# EasyEDA Pro project Athena.epro, schematic Schematic, sheet 2 of 4

## Sheets
2 Power: Page Name: Power
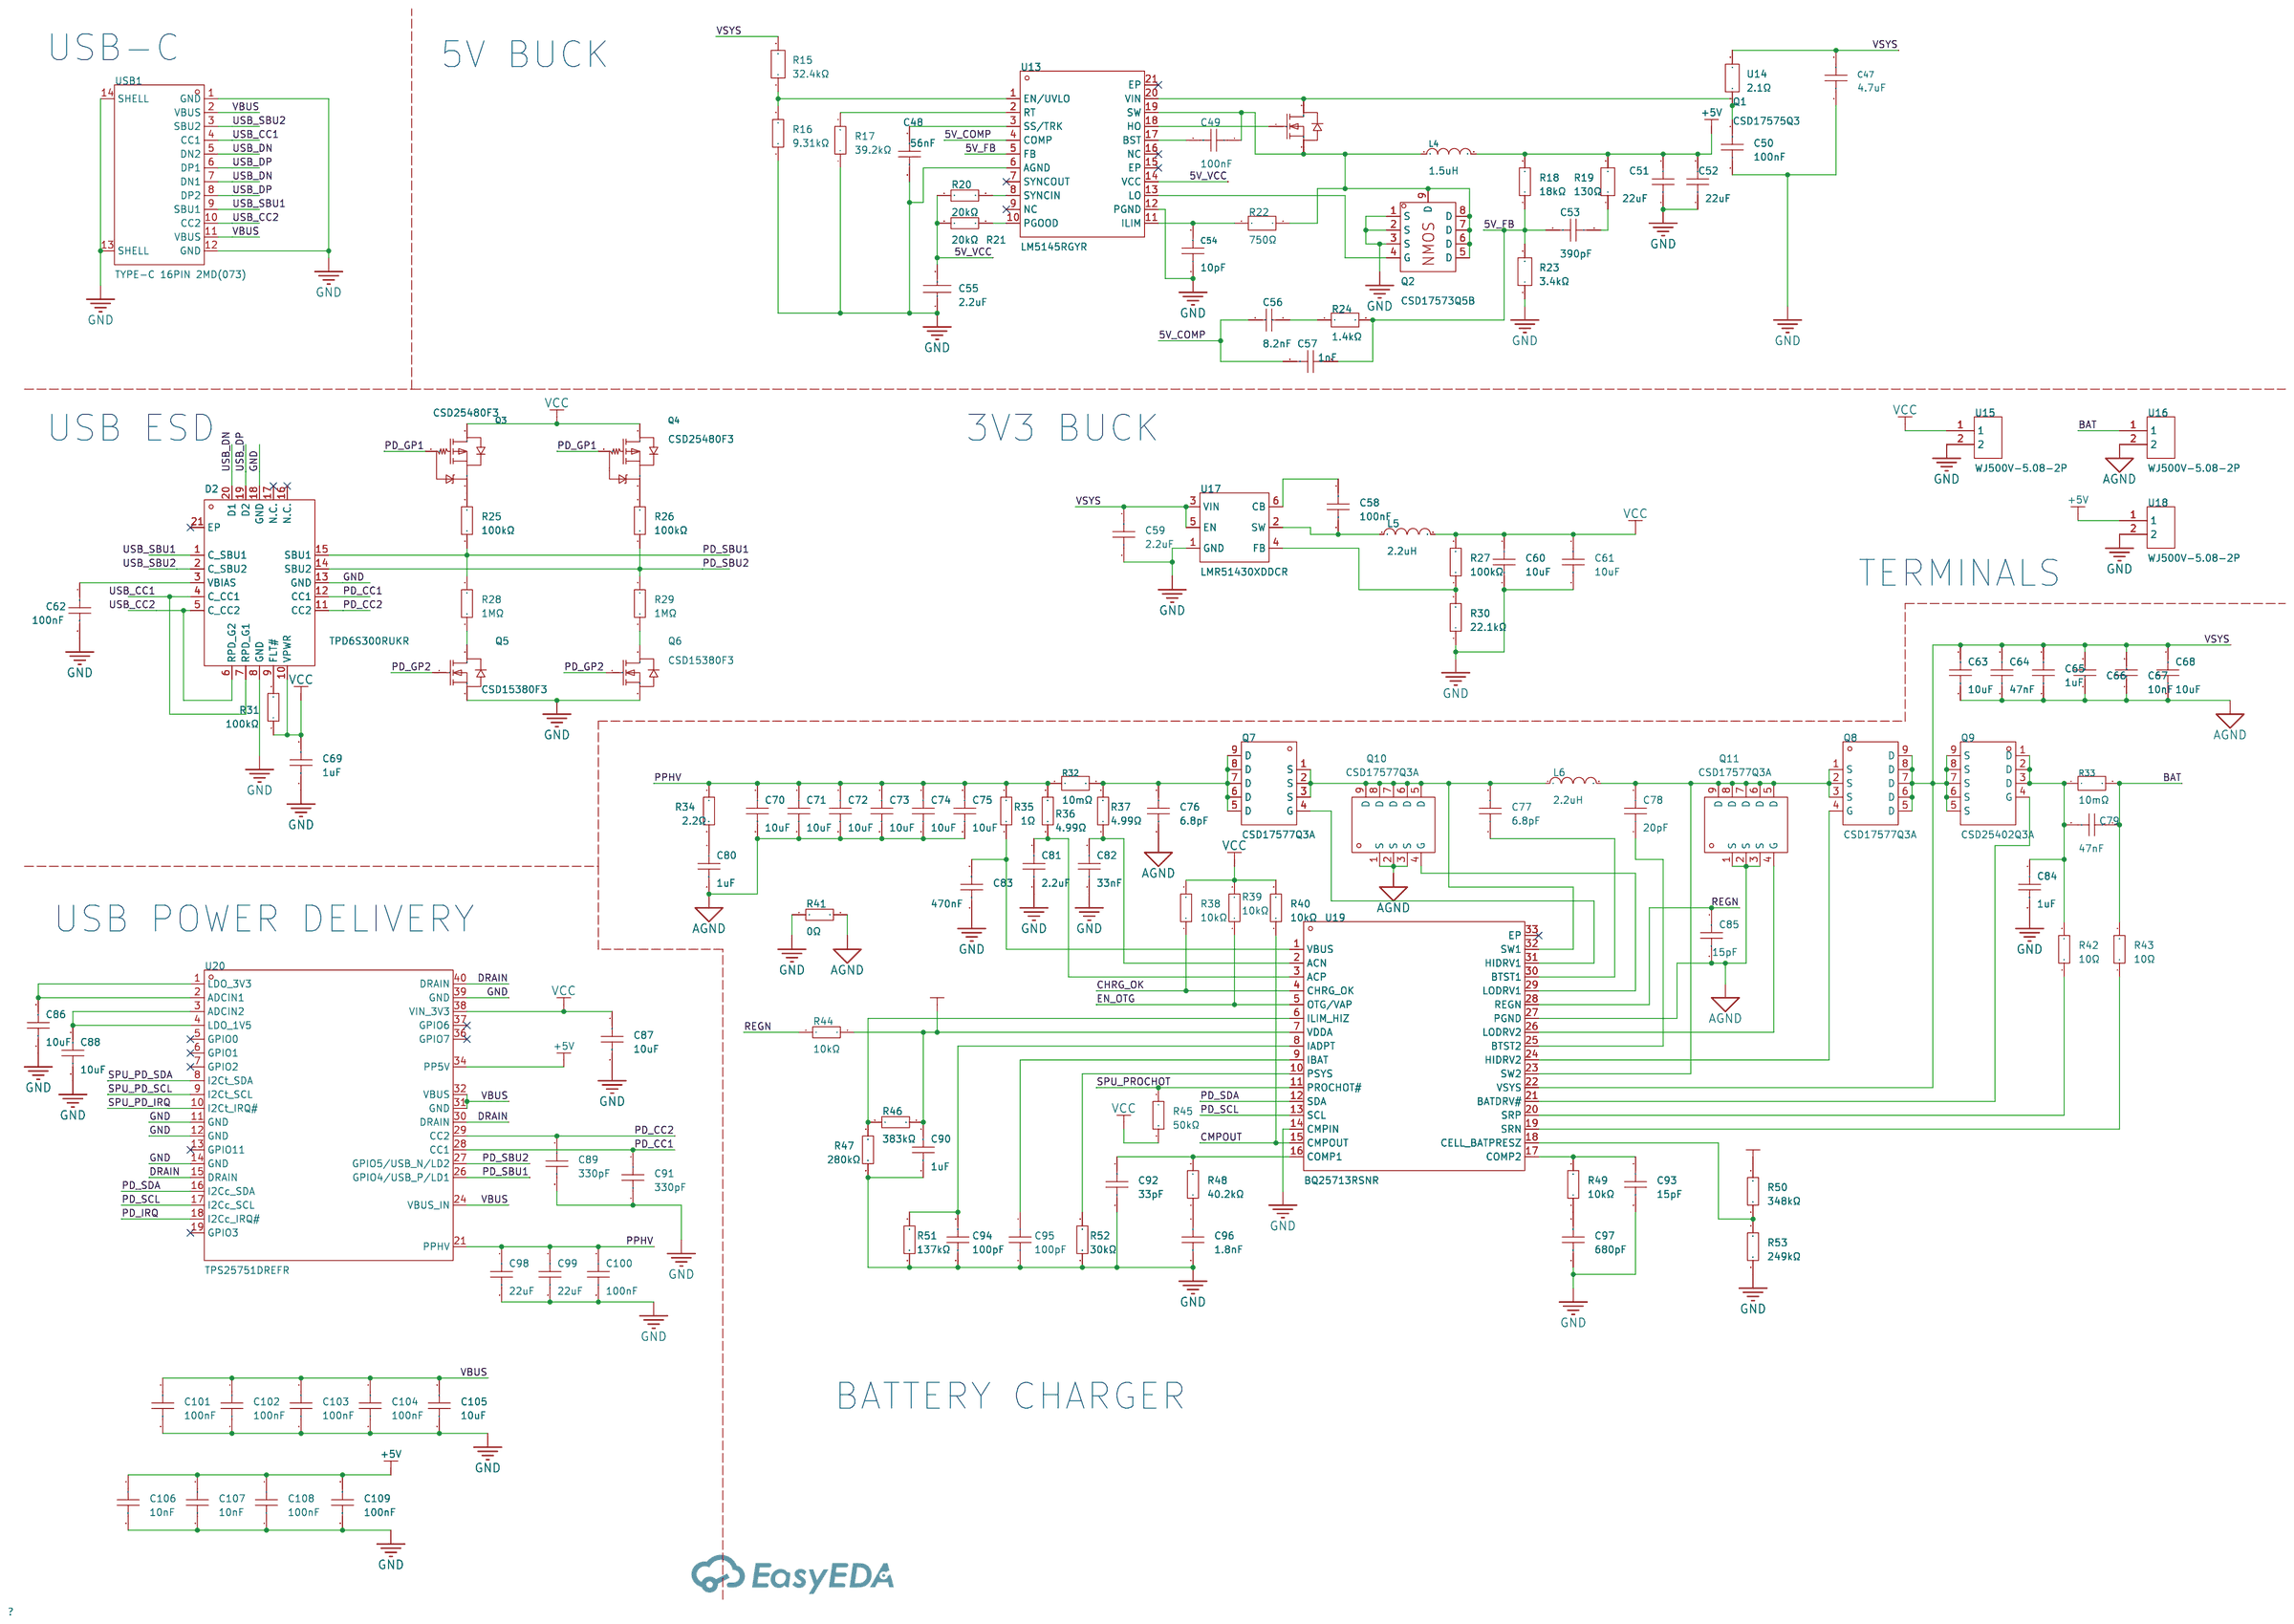
[diagram p1: Power]

## Parts
C47  4.7uF  [C1210]
C48  56nF  [C0603]
C49  100nF  [C0603]
C50  100nF  [C0603]
C51  22uF  [C0805]
C52  22uF  [C0805]
C53  390pF  [C0402]
C54  10pF  [C0603]
C55  2.2uF  [C0402]
C56  8.2nF  [C0402]
C57  1nF  [C0402]
C58  100nF  [C0402]
C59  2.2uF  [C0805]
C60  10uF  [C0603]
C61  10uF  [C0603]
C62  100nF  [C0402]
C63  10uF  [C0805]
C64  47nF  [C0805]
C65  1uF  [C0805]
C66  100pF  [C0805]
C67  10nF  [C0805]
C68  10uF  [C0805]
C69  1uF  [C0402]
C70  10uF  [C0805]
C71  10uF  [C0805]
C72  10uF  [C0805]
C73  10uF  [C0805]
C74  10uF  [C0805]
C75  10uF  [C0805]
C76  6.8pF  [C0603]
C77  6.8pF  [C0603]
C78  20pF  [C0603]
C79  47nF  [C0402]
C80  1uF  [C0402]
C81  2.2uF  [C0603]
C82  33nF  [C0603]
C83  470nF  [C0603]
C84  1uF  [C0402]
C85  15pF  [C0402]
C86  10uF  [C0402]
C87  10uF  [C0402]
C88  10uF  [C0402]
C89  330pF  [C0402]
C90  1uF  [C0402]
C91  330pF  [C0402]
C92  33pF  [C0402]
C93  15pF  [C0402]
C94  100pF  [C0402]
C95  100pF  [C0402]
C96  1.8nF  [C0402]
C97  680pF  [C0402]
C98  22uF  [C0805]
C99  22uF  [C0805]
C100  100nF  [C0402]
C101  100nF  [C0402]
C102  100nF  [C0402]
C103  100nF  [C0402]
C104  100nF  [C0402]
C105  10uF  [C0805]
C106  10nF  [C0402]
C107  10nF  [C0402]
C108  100nF  [C0805]
C109  100nF  [C0805]
D2  TPD6S300RUKR  [WQFN-20_L3.0-W3.0-P0.40-BL-EP1.7]
L4  1.5uH  [IND-SMD_L11.5-W10.0_104CDMCCDS]
L5  2.2uH  [L1206]
L6  2.2uH  [IND-SMD_L4.4-W4.2]
Q1  CSD17575Q3  [VSON-CLIP-8_L3.3-W3.3-P0.65-BL]
Q2  CSD17573Q5B  [POWERVDFN-8_L6.0-W5.0-P1.27-BL]
Q3  CSD25480F3  [PICOSTAR-3_L0.7-W0.6-P0.40-TL]
Q4  CSD25480F3  [PICOSTAR-3_L0.7-W0.6-P0.40-TL]
Q5  CSD15380F3  [PICOSTAR-3_L0.7-W0.6-P0.35-TL]
Q6  CSD15380F3  [PICOSTAR-3_L0.7-W0.6-P0.35-TL]
Q7  CSD17577Q3A  [VSONP-8_L3.1-W3.1-P0.65-LS3.5-BL]
Q8  CSD17577Q3A  [VSONP-8_L3.1-W3.1-P0.65-LS3.5-BL]
Q9  CSD25402Q3A  [VSONP-8_L3.1-W3.1-P0.65-LS3.5-BL]
Q10  CSD17577Q3A  [VSONP-8_L3.1-W3.1-P0.65-LS3.5-BL]
Q11  CSD17577Q3A  [VSONP-8_L3.1-W3.1-P0.65-LS3.5-BL]
R15  32.4kΩ  [R0603]
R16  9.31kΩ  [R0603]
R17  39.2kΩ  [R0402]
R18  18kΩ  [R0603]
R19  130Ω  [R0402]
R20  20kΩ  [R0603]
R21  20kΩ  [R0603]
R22  750Ω  [R0402]
R23  3.4kΩ  [R0402]
R24  1.4kΩ  [R0603]
R25  100kΩ  [R0402]
R26  100kΩ  [R0402]
R27  100kΩ  [R0402]
R28  1MΩ  [R0402]
R29  1MΩ  [R0402]
R30  22.1kΩ  [R0402]
R31  100kΩ  [R0402]
R32  10mΩ  [R1206]
R33  10mΩ  [R1206]
R34  2.2Ω  [R0402]
R35  1Ω  [R0402]
R36  4.99Ω  [R0402]
R37  4.99Ω  [R0402]
R38  10kΩ  [R0402]
R39  10kΩ  [R0402]
R40  10kΩ  [R0402]
R41  0Ω  [R0402]
R42  10Ω  [R0402]
R43  10Ω  [R0402]
R44  10kΩ  [R0402]
R45  50kΩ  [R0402]
R46  383kΩ  [R0402]
R47  280kΩ  [R0402]
R48  40.2kΩ  [R0402]
R49  10kΩ  [R0402]
R50  348kΩ  [R0402]
R51  137kΩ  [R0402]
R52  30kΩ  [R0402]
R53  249kΩ  [R0402]
U13  LM5145RGYR  [VQFN-20_L4.5-W3.5-P0.50-BL-EP]
U14  2.1Ω  [R0603]
U15  WJ500V-5.08-2P  [CONN-TH_2P-P5.00_WJ500V-5.08-2P]
U16  WJ500V-5.08-2P  [CONN-TH_2P-P5.00_WJ500V-5.08-2P]
U17  LMR51430XDDCR  [SOT-23-6_L2.9-W1.6-P0.95-LS2.8-BL]
U18  WJ500V-5.08-2P  [CONN-TH_2P-P5.00_WJ500V-5.08-2P]
U19  BQ25713RSNR  [QFN-32_L4.0-W4.0-P0.40-TL-EP2.8]
U20  TPS25751DREFR  [QFN-38_L6.0-W4.0-P0.40-TL-EP_TI_REF0038A]
USB1  TYPE-C 16PIN 2MD(073)  [USB-C-SMD_TYPE-C-6PIN-2MD-073]

## Library data of the parts
C47 = GRM32ER71H475KA88L: Capacitance: Tolerance:±10% Tolerance:±10% Voltage Rated: Temperature Coefficient:; LCSC Part Name: 4.7uF ±10% 50V; Supplier Part: C86052; Manufacturer: muRata(村田); Supplier Footprint: 1210; JLCPCB Part Class: Extended Part; Datasheet: https://atta.szlcsc.com/upload/public/pdf/source/20200305/C490387_23319AE8C154DEB24C505E6C82A8106A.pdf; Supplier: LCSC; Tolerance: ±10%
C48 = CC0603KRX7R9BB563: Capacitance: Tolerance:±10% Tolerance:±10% Voltage Rated: Temperature Coefficient:; LCSC Part Name: 56nF ±10% 50V; Supplier Part: C282072; Manufacturer: YAGEO(国巨); Supplier Footprint: 0603; JLCPCB Part Class: Extended Part; Datasheet: https://atta.szlcsc.com/upload/public/pdf/source/20180910/C282072_33301C7F631E79921B82A8DAC6BCC5B3.pdf; Supplier: LCSC; Tolerance: ±10%
C49 C50 = CC0603KRX7R9BB104: Capacitance:100nF Tolerance:±10% Tolerance:±10% Voltage Rating:50V Temperature Coefficient:X7R; LCSC Part Name: 100nF ±10% 50V; Supplier Part: C14663; Manufacturer: YAGEO(国巨); Supplier Footprint: 0603; JLCPCB Part Class: Basic Part; Datasheet: https://atta.szlcsc.com/upload/public/pdf/source/20250214/096C4C206003071F5D32E5F0D8E7F8DF.pdf; Supplier: LCSC; Tolerance: ±10%; Voltage Rating: 50V; Temperature Coefficient: X7R
C51 C52 = CL21A226MAYNNNE: Capacitance:22uF Tolerance:±20% Tolerance:±20% Voltage Rating:25V Temperature Coefficient:X5R; LCSC Part Name: 22uF ±20% 25V; Supplier Part: C602037; Manufacturer: SAMSUNG(三星); Supplier Footprint: 0805; JLCPCB Part Class: Extended Part; Datasheet: https://item.szlcsc.com/datasheet/CL21A226MAYNNNE/631473.html; Supplier: LCSC; Tolerance: ±20%; Voltage Rating: 25V; Temperature Coefficient: X5R
C53 = GRM155R71H391KA01D: Capacitance: Tolerance:±10% Tolerance:±10% Voltage Rated: Temperature Coefficient:; LCSC Part Name: 390pF ±10% 50V NRND物料(将要停产) 原厂不接订单; Supplier Part: C185563; Manufacturer: muRata(村田); Supplier Footprint: 0402; JLCPCB Part Class: Extended Part; Datasheet: https://atta.szlcsc.com/upload/public/pdf/source/20190725/C185563_90001B6F14E9F7B861ADEBE8CCB1D839.pdf; Supplier: LCSC; Tolerance: ±10%
C54 = CC0603JRNPO0BN100: Capacitance: Tolerance:±5% Tolerance:±5% Voltage Rated: Temperature Coefficient:; LCSC Part Name: 10pF ±5% 100V; Supplier Part: C576799; Manufacturer: YAGEO(国巨); Supplier Footprint: 0603; JLCPCB Part Class: Extended Part; Datasheet: https://atta.szlcsc.com/upload/public/pdf/source/20200814/C576799_FFC052976BB908963E8862AC2CBE779D.pdf; Supplier: LCSC; Tolerance: ±5%
C55 = CL05A225MQ5NSNC: Capacitance:2.2uF Tolerance:±20% Tolerance:±20% Voltage Rating:6.3V Temperature Coefficient:X5R; LCSC Part Name: 2.2uF ±20% 6.3V; Supplier Part: C12530; Manufacturer: SAMSUNG(三星); Supplier Footprint: 0402; JLCPCB Part Class: Basic Part; Datasheet: https://item.szlcsc.com/datasheet/CL05A225MQ5NSNC/13164.html; Supplier: LCSC; Tolerance: ±20%; Voltage Rating: 6.3V; Temperature Coefficient: X5R
C56 = CC0402KRX7R9BB822: Capacitance: Tolerance:±10% Tolerance:±10% Voltage Rated: Temperature Coefficient:; LCSC Part Name: 8.2nF ±10% 50V; Supplier Part: C107032; Manufacturer: YAGEO(国巨); Supplier Footprint: 0402; JLCPCB Part Class: Extended Part; Datasheet: https://atta.szlcsc.com/upload/public/pdf/source/20170914/C128857_1505359892143968080.pdf; Supplier: LCSC; Tolerance: ±10%
C57 = TCC0402X7R102M500AT: Capacitance:1000pF Tolerance:±20% Tolerance:±20% Voltage Rating:50V Temperature Coefficient:X7R; LCSC Part Name: 1nF ±20% 50V; Supplier Part: C696907; Manufacturer: CCTC(三环); Supplier Footprint: 0402; JLCPCB Part Class: Extended Part; Datasheet: https://atta.szlcsc.com/upload/public/pdf/source/20200707/C696841_89A2C111301AB76AE7642008585E7A11.pdf; Supplier: LCSC; Tolerance: ±20%; Voltage Rating: 50V; Temperature Coefficient: X7R
C58 C62 C100-C104 = GRM155R71H104KE14D: Capacitance: Tolerance:±10% Tolerance:±10% Voltage Rated: Temperature Coefficient:; LCSC Part Name: 100nF ±10% 50V; Supplier Part: C77020; Manufacturer: muRata(村田); Supplier Footprint: 0402; JLCPCB Part Class: Extended Part; Datasheet: https://atta.szlcsc.com/upload/public/pdf/source/20180326/C77020_39BD49C951FF1AF0DB1F1FAC5AC1E401.pdf; Supplier: LCSC; Tolerance: ±10%; Standardization Check: false
C59 = CL21A225KBQNNNE: Capacitance:2.2uF Tolerance:±10% Tolerance:±10% Voltage Rating:50V Temperature Coefficient:X5R; LCSC Part Name: 2.2uF ±10% 50V; Supplier Part: C377773; Manufacturer: SAMSUNG(三星); Supplier Footprint: 0805; JLCPCB Part Class: Basic Part; Datasheet: https://item.szlcsc.com/datasheet/CL21A225KBQNNNE/350246.html; Supplier: LCSC; Tolerance: ±10%; Voltage Rating: 50V; Temperature Coefficient: X5R; Standardization Check: false
C60 C61 = CL10A106MA8NRNC: Capacitance:10uF Tolerance:±20% Tolerance:±20% Voltage Rating:25V Temperature Coefficient:X5R; LCSC Part Name: 10uF ±20% 25V; Supplier Part: C96446; Manufacturer: SAMSUNG(三星); Supplier Footprint: 0603; JLCPCB Part Class: Basic Part; Datasheet: https://item.szlcsc.com/datasheet/CL10A106MA8NRNC/97651.html; Supplier: LCSC; Tolerance: ±20%; Voltage Rating: 25V; Temperature Coefficient: X5R; Standardization Check: false
C63 C68 C70-C75 = GRM21BR61H106KE43L: Capacitance: Tolerance:±10% Tolerance:±10% Voltage Rated: Temperature Coefficient:; LCSC Part Name: 10uF ±10% 50V; Supplier Part: C440198; Manufacturer: muRata(村田); Supplier Footprint: 0805; JLCPCB Part Class: Basic Part; Datasheet: https://atta.szlcsc.com/upload/public/pdf/source/20230811/95AAE0C9AF55EDC31B7A4D8B733F534E.pdf; Supplier: LCSC; Tolerance: ±10%; Standardization Check: false
C64 = CL21B473KBCNNNC: Capacitance: Tolerance:±10% Tolerance:±10% Voltage Rated: Temperature Coefficient:; LCSC Part Name: 47nF ±10% 50V; Supplier Part: C53134; Manufacturer: SAMSUNG(三星); Supplier Footprint: 0805; JLCPCB Part Class: Basic Part; Datasheet: https://atta.szlcsc.com/upload/public/pdf/source/20160218/1457707763339.pdf; Supplier: LCSC; Tolerance: ±10%
C65 = CL21B105KBFNNNE: Capacitance:1uF Tolerance:±10% Tolerance:±10% Voltage Rating:50V Temperature Coefficient:X7R; LCSC Part Name: 1uF ±10% 50V; Supplier Part: C28323; Manufacturer: SAMSUNG(三星); Supplier Footprint: 0805; JLCPCB Part Class: Basic Part; Datasheet: https://item.szlcsc.com/datasheet/CL21B105KBFNNNE/29074.html; Supplier: LCSC; Tolerance: ±10%; Voltage Rating: 50V; Temperature Coefficient: X7R
C66 = CL21C101JBANNNC: Capacitance:100pF Tolerance:±5% Tolerance:±5% Voltage Rating:50V Temperature Coefficient:C0G; LCSC Part Name: 100pF ±5% 50V; Supplier Part: C1790; Manufacturer: SAMSUNG(三星); Supplier Footprint: 0805; JLCPCB Part Class: Basic Part; Datasheet: https://item.szlcsc.com/datasheet/CL21C101JBANNNC/2142.html; Supplier: LCSC; Tolerance: ±5%; Voltage Rating: 50V; Temperature Coefficient: C0G
C67 = CL21B103KBANNNC: Capacitance:10nF Tolerance:±10% Tolerance:±10% Voltage Rating:50V Temperature Coefficient:X7R; LCSC Part Name: 10nF ±10% 50V; Supplier Part: C1710; Manufacturer: SAMSUNG(三星); Supplier Footprint: 0805; JLCPCB Part Class: Basic Part; Datasheet: https://item.szlcsc.com/datasheet/CL21B103KBANNNC/2062.html; Supplier: LCSC; Tolerance: ±10%; Voltage Rating: 50V; Temperature Coefficient: X7R
C69 C80 C84 C90 = CL05A105KA5NQNC: Capacitance:1uF Tolerance:±10% Tolerance:±10% Voltage Rating:25V Temperature Coefficient:X5R; LCSC Part Name: 1uF ±10% 25V; Supplier Part: C52923; Manufacturer: SAMSUNG(三星); Supplier Footprint: 0402; JLCPCB Part Class: Basic Part; Datasheet: https://item.szlcsc.com/datasheet/CL05A105KA5NQNC/53938.html; Supplier: LCSC; Tolerance: ±10%; Voltage Rating: 25V; Temperature Coefficient: X5R; Standardization Check: false
C76 C77 = CC0603CRNPO9BN6R8: Capacitance:6.8pF Voltage Rating:50V Temperature Coefficient:NP0; LCSC Part Name: ±0.25pF 6.8pF 50V; Supplier Part: C282251; Manufacturer: YAGEO(国巨); Supplier Footprint: 0603; JLCPCB Part Class: Extended Part; Datasheet: https://item.szlcsc.com/datasheet/CC0603CRNPO9BN6R8/268271.html; Supplier: LCSC; Voltage Rating: 50V; Temperature Coefficient: NP0
C78 = CC0603JRNPO9BN200: Capacitance: Tolerance:±5% Tolerance:±5% Voltage Rated: Temperature Coefficient:; LCSC Part Name: 20pF ±5% 50V; Supplier Part: C105621; Manufacturer: YAGEO(国巨); Supplier Footprint: 0603; JLCPCB Part Class: Extended Part; Datasheet: https://atta.szlcsc.com/upload/public/pdf/source/20170505/1493957838062.pdf; Supplier: LCSC; Tolerance: ±5%
C79 = CC0402KRX7R9BB473: Capacitance:47nF Tolerance:±10% Tolerance:±10% Voltage Rating:50V Temperature Coefficient:X7R; LCSC Part Name: 47nF ±10% 50V; Supplier Part: C272875; Manufacturer: YAGEO(国巨); Supplier Footprint: 0402; JLCPCB Part Class: Extended Part; Datasheet: https://item.szlcsc.com/datasheet/CC0402KRX7R9BB473/261267.html; Supplier: LCSC; Tolerance: ±10%; Voltage Rating: 50V; Temperature Coefficient: X7R; Standardization Check: false
C81 = CL10A225KB8NNNC: Capacitance:2.2uF Tolerance:±10% Tolerance:±10% Voltage Rating:50V Temperature Coefficient:X5R; LCSC Part Name: 2.2uF ±10% 50V; Supplier Part: C913904; Manufacturer: SAMSUNG(三星); Supplier Footprint: 0603; JLCPCB Part Class: Extended Part; Datasheet: https://item.szlcsc.com/datasheet/CL10A225KB8NNNC/984470.html; Supplier: LCSC; Tolerance: ±10%; Voltage Rating: 50V; Temperature Coefficient: X5R
C82 = CL10B333KB8NNNC: Capacitance:33nF Tolerance:±10% Tolerance:±10% Voltage Rating:50V Temperature Coefficient:X7R; LCSC Part Name: 33nF ±10% 50V; Supplier Part: C21117; Manufacturer: SAMSUNG(三星); Supplier Footprint: 0603; JLCPCB Part Class: Basic Part; Datasheet: https://item.szlcsc.com/datasheet/CL10B333KB8NNNC/21829.html; Supplier: LCSC; Tolerance: ±10%; Voltage Rating: 50V; Temperature Coefficient: X7R; Standardization Check: false
C83 = CC0603KRX7R9BB474: Capacitance:470nF Tolerance:±10% Tolerance:±10% Voltage Rating:50V Temperature Coefficient:X7R; LCSC Part Name: 470nF ±10% 50V; Supplier Part: C513577; Manufacturer: YAGEO(国巨); Supplier Footprint: 0603; JLCPCB Part Class: Extended Part; Datasheet: https://item.szlcsc.com/datasheet/CC0603KRX7R9BB474/528404.html; Supplier: LCSC; Tolerance: ±10%; Voltage Rating: 50V; Temperature Coefficient: X7R; Standardization Check: false
C85 C93 = 0402CG150J500NT: Capacitance:15pF Tolerance:±5% Tolerance:±5% Voltage Rating:50V Temperature Coefficient:C0G; LCSC Part Name: 15pF ±5% 50V; Supplier Part: C1548; Manufacturer: FH(风华); Supplier Footprint: 0402; JLCPCB Part Class: Basic Part; Datasheet: https://item.szlcsc.com/datasheet/0402CG150J500NT/1900.html; Supplier: LCSC; Tolerance: ±5%; Voltage Rating: 50V; Temperature Coefficient: C0G; Standardization Check: false
C86-C88 = CL05A106MP5NUNC_C315248: Capacitance:10uF Tolerance:±20% Tolerance:±20% Voltage Rating:10V Temperature Coefficient:X5R; LCSC Part Name: 10uF ±20% 10V; Supplier Part: C315248; Manufacturer: SAMSUNG(三星); Manufacturer Part: CL05A106MP5NUNC; Supplier Footprint: 0402; JLCPCB Part Class: Extended Part; Datasheet: https://item.szlcsc.com/datasheet/CL05A106MP5NUNC/297154.html; Supplier: LCSC; Tolerance: ±20%; Voltage Rating: 10V; Temperature Coefficient: X5R; Standardization Check: false
C89 C91 = CC0402KRX7R9BB331: Capacitance:330pF Tolerance:±10% Tolerance:±10% Voltage Rating:50V Temperature Coefficient:X7R; LCSC Part Name: 330pF ±10% 50V; Supplier Part: C106206; Manufacturer: YAGEO(国巨); Supplier Footprint: 0402; JLCPCB Part Class: Extended Part; Datasheet: https://item.szlcsc.com/datasheet/CC0402KRX7R9BB331/107421.html; Supplier: LCSC; Tolerance: ±10%; Voltage Rating: 50V; Temperature Coefficient: X7R; Standardization Check: false
C92 = CC0402JRNPO9BN330: Capacitance: Tolerance:±5% Tolerance:±5% Voltage Rated: Temperature Coefficient:; LCSC Part Name: 33pF ±5% 50V; Supplier Part: C107005; Manufacturer: YAGEO(国巨); Supplier Footprint: 0402; JLCPCB Part Class: Extended Part; Datasheet: https://atta.szlcsc.com/upload/public/pdf/source/20181008/C309499_21CC21451B82C39E3D92150FD6B30293.pdf; Supplier: LCSC; Tolerance: ±5%; Standardization Check: false
C94 C95 = 0402CG101J500NT: Capacitance: Tolerance:±5% Tolerance:±5% Voltage Rated: Temperature Coefficient:; LCSC Part Name: 100pF ±5% 50V; Supplier Part: C1546; Manufacturer: FH(风华); Supplier Footprint: 0402; JLCPCB Part Class: Basic Part; Datasheet: https://atta.szlcsc.com/upload/public/pdf/source/20200305/C486355_26A10D38EF8C2A5C37091D0039909270.pdf; Supplier: LCSC; Tolerance: ±5%; Standardization Check: false
C96 = CC0402JRX7R9BB182: Capacitance:1.8nF Tolerance:±5% Tolerance:±5% Voltage Rating:50V Temperature Coefficient:X7R; LCSC Part Name: 1.8nF ±5% 50V; Supplier Part: C527007; Manufacturer: YAGEO(国巨); Supplier Footprint: 0402; JLCPCB Part Class: Extended Part; Datasheet: https://item.szlcsc.com/datasheet/CC0402JRX7R9BB182/545433.html; Supplier: LCSC; Tolerance: ±5%; Voltage Rating: 50V; Temperature Coefficient: X7R; Standardization Check: false
C97 = CC0402KRX7R9BB681: Capacitance:680pF Tolerance:±10% Tolerance:±10% Voltage Rating:50V Temperature Coefficient:X7R; LCSC Part Name: 680pF ±10% 50V; Supplier Part: C107030; Manufacturer: YAGEO(国巨); Supplier Footprint: 0402; JLCPCB Part Class: Extended Part; Datasheet: https://item.szlcsc.com/datasheet/CC0402KRX7R9BB681/108246.html; Supplier: LCSC; Tolerance: ±10%; Voltage Rating: 50V; Temperature Coefficient: X7R; Standardization Check: false
C98 C99 = CL21A226MAQNNNE: Capacitance:22uF Tolerance:±20% Tolerance:±20% Voltage Rating:25V Temperature Coefficient:X5R; LCSC Part Name: 22uF ±20% 25V; Supplier Part: C45783; Manufacturer: SAMSUNG(三星); Supplier Footprint: 0805; JLCPCB Part Class: Basic Part; Datasheet: https://item.szlcsc.com/datasheet/CL21A226MAQNNNE/46786.html; Supplier: LCSC; Tolerance: ±20%; Voltage Rating: 25V; Temperature Coefficient: X5R; Standardization Check: false
C105 = GRM21BR61H106KE43L: Capacitance: Tolerance:±10% Tolerance:±10% Voltage Rated: Temperature Coefficient:; LCSC Part Name: 10uF ±10% 50V; Supplier Part: C440198; Manufacturer: muRata(村田); Supplier Footprint: 0805; JLCPCB Part Class: Basic Part; Datasheet: https://atta.szlcsc.com/upload/public/pdf/source/20230811/95AAE0C9AF55EDC31B7A4D8B733F534E.pdf; Supplier: LCSC; Tolerance: ±10%
C106 C107 = CL05B103KB5NNNC: Capacitance:10nF Tolerance:±10% Tolerance:±10% Voltage Rating:50V Temperature Coefficient:X7R; LCSC Part Name: 10nF ±10% 50V; Supplier Part: C15195; Manufacturer: SAMSUNG(三星); Supplier Footprint: 0402; JLCPCB Part Class: Basic Part; Datasheet: https://item.szlcsc.com/datasheet/CL05B103KB5NNNC/15869.html; Supplier: LCSC; Tolerance: ±10%; Voltage Rating: 50V; Temperature Coefficient: X7R; Standardization Check: false
C108 C109 = CC0805KRX7R9BB104: Capacitance:100nF Tolerance:±10% Tolerance:±10% Voltage Rating:50V Temperature Coefficient:X7R; LCSC Part Name: 100nF ±10% 50V; Supplier Part: C49678; Manufacturer: YAGEO(国巨); Supplier Footprint: 0805; JLCPCB Part Class: Basic Part; Datasheet: https://item.szlcsc.com/datasheet/CC0805KRX7R9BB104/50686.html; Supplier: LCSC; Tolerance: ±10%; Voltage Rating: 50V; Temperature Coefficient: X7R; Standardization Check: false
D2 = TPD6S300RUKR: Supplier Part: C2649810; Manufacturer: TI(德州仪器); Supplier Footprint: WQFN-20-EP(3x3); JLCPCB Part Class: Extended Part; Datasheet: https://www.ti.com/cn/lit/gpn/tpd6s300; Supplier: LCSC
L4 = 104CDMCCDS-1R5MC: Inductance: Tolerance:±20% Tolerance:±20% Rated Current: Saturation Current (Isat):29A DC Resistance (DCR): Type:- Ratings:-; LCSC Part Name: 1.5uH ±20% 29A; Supplier Part: C516064; Manufacturer: Sumida(胜美达); Supplier Footprint: SMD,11.5x10mm; JLCPCB Part Class: Extended Part; Datasheet: https://atta.szlcsc.com/upload/public/pdf/source/20180125/C167296_15168662824641303024.pdf; Supplier: LCSC; Tolerance: ±20%; Saturation Current (Isat): 29A
L5 = CMP321609UD2R2MT: Inductance: Tolerance:±20% Tolerance:±20% Rated Current: Saturation Current (Isat):- DC Resistance (DCR): Q @ Freq:- Frequency - Self Resonant: Ratings:; LCSC Part Name: 2.2uH ±20%; Supplier Part: C139249; Manufacturer: FH(风华); Supplier Footprint: 1206; JLCPCB Part Class: Extended Part; Datasheet: https://atta.szlcsc.com/upload/public/pdf/source/20230223/9514AABD49028510480EFFDFC3336E06.pdf; Supplier: LCSC; Tolerance: ±20%; Standardization Check: false
L6 = FXL0420-2R2-M: Inductance:2.2uH Tolerance:±20% Tolerance:±20% Current Rating:4.5A Current - Saturation(Isat):5A DC Resistance(DCR):58mΩ Type:Molded Inductor; LCSC Part Name: 2.2uH ±20% 5A; Supplier Part: C167206; Manufacturer: cjiang(长江微电); Supplier Footprint: SMD,4.2x4.4mm; JLCPCB Part Class: Extended Part; Datasheet: https://atta.szlcsc.com/upload/public/pdf/source/20250421/DC75C633ACB13F952A25DE8912719752.pdf; Supplier: LCSC; Tolerance: ±20%; Current Rating: 4.5A; Current - Saturation(Isat): 5A; DC Resistance(DCR): 58mΩ; Type: Molded Inductor
Q1 = CSD17575Q3: Number:1 N-Channel Drain to Source Voltage:30V Current - Continuous Drain(Id):60A RDS(on):1.9mΩ@10V,25A Pd - Power Dissipation:2.8W Gate Threshold Voltage (Vgs(th)):1.4V Gate Charge(Qg):23nC@4.5V Input Capacitance(Ciss):4.42nF Reverse Transfer Capacitance; LCSC Part Name: 1个N沟道 耐压:30V 电流:60A; Supplier Part: C529277; Manufacturer: TI(德州仪器); Supplier Footprint: VSON-CLIP-8(3.3x3.3); JLCPCB Part Class: Extended Part; Datasheet: https://www.ti.com/cn/lit/gpn/csd17575q3; Supplier: LCSC; Number: 1 N-Channel; Drain to Source Voltage: 30V; Current - Continuous Drain(Id): 60A; RDS(on): 1.9mΩ@10V,25A; Pd - Power Dissipation: 2.8W; Gate Threshold Voltage (Vgs(th)): 1.4V; Gate Charge(Qg): 23nC@4.5V; Input Capacitance(Ciss): 4.42nF; Reverse Transfer Capacitance (Crss@Vds): 204pF; Operating Temperature: -55℃~+150℃
Q2 = CSD17573Q5B: Type:1 N-Channel Drain Source Voltage (Vdss): Continuous Drain Current (Id): Drain Source On Resistance (RDS(on)@Vgs,Id):1mΩ@10V,35A Power Dissipation (Pd): Gate Threshold Voltage (Vgs(th)@Id):1.4V@250uA Total Gate Charge (Qg@Vgs):49nC@4.5V Input Capacita; LCSC Part Name: 1个N沟道 耐压:30V 电流:100A; Supplier Part: C202231; Manufacturer: TI(德州仪器); Supplier Footprint: PDFN-8(5x6); JLCPCB Part Class: Extended Part; Datasheet: https://www.ti.com/cn/lit/gpn/csd17573q5b; Supplier: LCSC; Type: 1 N-Channel; Drain Source On Resistance (RDS(on)@Vgs,Id): 1mΩ@10V,35A; Gate Threshold Voltage (Vgs(th)@Id): 1.4V@250uA; Total Gate Charge (Qg@Vgs): 49nC@4.5V; Input Capacitance (Ciss@Vds): 6920pF; Reverse Transfer Capacitance (Crss@Vds): 390pF; Operating Temperature: -55℃~+150℃